# EAGLE board Mk4 Final a (EAGLE 9.0.1), part 1 of 3 (continued)
## Placement (x,y rotation side) (continued)
C90  0402/4u7/6V3/X5R  [C0402-SMALLER]  16.7,30.2 90 bottom
C91  0402/100n/10V/X5R  [C0402-SMALLER]  15.8,15 270 bottom
C92  0402/100n/10V/X5R  [C0402-SMALLER]  23.8,22.25 270 bottom
C93  0805/10u/10V/X5R  [C0805-N]  24.3,28.75 180 bottom
C94  0402/100n/10V/X5R  [C0402-SMALLER]  11.3,22.25 0 bottom
C95  0402/100n/10V/X5R  [C0402-SMALLER]  24.55,25.75 180 bottom
C96  0402/100n/10V/X5R  [C0402-SMALLER]  24.8,18.75 180 bottom
C97  0402/100n/10V/X5R  [C0402-SMALLER]  16.8,15 270 bottom
C98  0402/12p/50V/C0G  [C0402-SMALLER]  10.75,20.25 270 bottom
C99  0402/12p/50V/C0G  [C0402-SMALLER]  10.75,18.25 90 bottom
C100  0402/12p/50V/C0G  [C0402-SMALLER]  27.55,21.75 270 bottom
C101  0402/12p/50V/C0G  [C0402-SMALLER]  27.55,23.75 90 bottom
C102  0402/100n/10V/X5R  [C0402-SMALLER]  74.8,19.5 180 bottom
C103  0402/120p/50V/C0G  [C0402-SMALLER]  27.75,14.35 270 bottom
C104  0402/100n/10V/X5R  [C0402-SMALLER]  84.05,10 90 bottom
C105  0402/220n/6V3/X5R  [C0402-SMALLER]  23.75,60.4 180 bottom
C106  0402/220n/6V3/X5R  [C0402-SMALLER]  23.8,57.5 180 bottom
C107  0402/100n/10V/X5R  [C0402-SMALLER]  79.15,6.5 270 bottom
C108  0402/100n/10V/X5R  [C0402-SMALLER]  85.8,9.5 270 bottom
D1  MMSZ5231BT1G  [SOD123]  98.8,25.5 90 bottom
D2  LXES15AAA1-153  [R0402-SMALLER]  111.8,34.5 0 bottom
FID1  FIDUCIAL1X2.5-STOP  [FIDUCIAL-1X2.5-STOP]  95.1,11.1 270 top
FID2  FIDUCIAL1X2.5-STOP  [FIDUCIAL-1X2.5-STOP]  2.1,14.5 180 bottom
FID3  FIDUCIAL1X2.5-STOP  [FIDUCIAL-1X2.5-STOP]  82.9,67.9 180 top
FID4  FIDUCIAL1X2.5-STOP  [FIDUCIAL-1X2.5-STOP]  82.9,67.9 180 bottom
FID5  FIDUCIAL1X2.5-STOP  [FIDUCIAL-1X2.5-STOP]  2.1,14.5 180 top
FID6  FIDUCIAL1X2.5-STOP  [FIDUCIAL-1X2.5-STOP]  95.1,11.1 270 bottom
FL1  DEA202450BT-1294C1-H  [DEA202450BT]  10.8,25.75 270 bottom
IC1  MSP432E401  [QFP128-0.4]  59.8,53 0 bottom
IC2  AS4C4M16SA-7TCN  [TSOP54-400]  36.5,52.7 270 bottom
IC3  HDC2080DMBR  [SHT2X]  81.9,7 90 bottom
IC4  TCA9555RGER  [QFN-24]  78.05,26 270 bottom
IC5  SIM800C24 S2-10686-Z1L09  [SIM800C]  100.3,41 180 bottom
IC6  MX25R8035FM1IH1  [SO08-EIAJ]  72.5,43.15 270 bottom
IC7  TPD3E001DRL  [DRL-5]  76.05,73.5 90 bottom
IC8  BQ25601  [QFN-24]  41.05,24 270 bottom
IC9  TPS62822DLCR  [VSON-HR]  31.5,14.1 180 bottom
IC10  TPD3E001DRL  [DRL-5]  109.05,30.4 270 bottom
IC11  TLV9002IDGK  [VSSOP8]  80.8,54 180 bottom
IC12  SN74HC4066D  [SO14]  90.8,54.5 0 bottom
IC13  TPA2006D1  [VSON-8]  20.6,53.95 270 bottom
IC14  MX25R1635FM1IL0  [SO08-EIAJ]  13.55,40.25 90 bottom
IC15  CC3120R  [VQFN-64]  17.3,22.5 0 bottom
IC16  TMP102AIDRLR  [SOT563]  74.8,21 270 bottom
IC17  OPT3001DNPR  [USON-6]  83.1,10 180 top
IC18  DRV5055A1QDBZR  [SOT23-3]  88.05,9.25 180 bottom
J1  78723-1001  [MSIM-MOLEX-LWK]  117.3,22.25 180 bottom
J2  ER-CON50HT-1  [FH12-50S-0.5SH]  59.8,33.5 0 bottom
J3  2x5 1.27mm  [PINHEAD_2X05_127]  89.7,62.2 0 bottom
J4  GSM-COIL-ANT  [GSM-ANTENNA]  116.3,34.75 0 bottom
J5  S2B-PH-SM4-TB(LF)(SN)  [JST-2-SMD]  88.6,15.8 90 bottom
J7  SMA-142-0711-821/826  [J502-ND-142-0711-821/826-LWK1]  119.6,34.75 0 bottom
J8  H4P-SMD-2.0  [HW4-2.0-SWD-COMBINED]  39.55,74 172 bottom
J9  PJ-393-A  [PJ-393-A]  25.55,76.6 256 bottom
J10  H4P-SMD-2.0  [HW4-2.0-SWD-COMBINED]  14.55,67.75 160 bottom
J11  M02X2  [2X2]  100.3,9.65 315 bottom
JP1  1x5 1.27mm  [1X05-1.27MM]  11.82,14 0 bottom
JP2  1x03  [1X03_LOCK]  57.26,77.9 180 bottom
JP3  1x02 2MM  [1X02_2MM]  41.55,8.25 0 bottom
JP4  TC2030-MCP-NL  [TC2030-MCP-NL]  84.25,63.9 270 bottom
JP5  1x4 1.27mm  [1X04-1.27MM]  28.8,30.5 90 bottom
JP6  1x8  [1X08_LOCK]  2.05,26.75 90 bottom
JP7  1x14  [1X14_LOCK]  43.29,70.5 180 bottom
JP8  1x6  [1X06]  80.3,77 191 bottom
JP9  1x04_1.27MM  [1X04-1.27MM]  113.3,49.8 0 bottom
L1  SRN2512-2R2M  [1008]  36.05,19.75 270 bottom
L2  BLM18KG121TN1D  [WUERTH-0805]  66.3,72.75 0 bottom
L3  0402/0R/5%  [L0402]  112.3,37 270 bottom
L4  DFE201610E-R47M=P2  [0806]  35.3,15.15 90 bottom
L5  0402/0R/5%  [L0402]  110.55,66.5 110 bottom
L6  0402/0R/5%  [L0402]  3.8,23 0 bottom
L7  LQM2HPN2R2MG0L  [1008]  14.3,33.2 180 bottom
L8  LQM2HPN1R0MG0L  [1008]  17.3,33.5 270 bottom
L9  LQM2HPN2R2MG0L  [1008]  23.8,32 270 bottom
LAYERS1  LAYER_NUMBRS_4_SMALL  [LAYER_NUMBERS_4_SMALL]  57.3,23.5 0 top
LCD  ER-TFT024-3  [ER-TFT024-3]  59.8,33.5 0 top
LED1  WS2812B  [WS2812B]  52.3,76.5 180 top
LED2  WS2812B  [WS2812B]  67.3,76.5 180 top
LED3  0603 RED  [LED-0603-CORRECT]  61.07,74.5 90 top
LED4  0603 GREEN  [LED-0603-CORRECT]  58.53,74.5 90 top
LED5  LED 5MM  [LED5MM]  33.8,10 0 top
LED6  0603 RED  [LED-0603-CORRECT]  43.55,28.75 180 bottom
LOGO1  LOGO_SIM  [SIM_ICON]  98.8,20 0 bottom
LOGO2  LOGO_MICROPYTHON-6MM  [LOGO_MICROPYTHON_6MM]  78.55,45.7 0 bottom
LOGO3  LOGO_HCD-4MM  [LOGO_HDC_4MM]  76.2,57.4 0 bottom
LOGO4  LOGO_TI-BY-4MM  [LOGO_TI_BY_4MM]  82.3,62 0 bottom
LOGO5  EMFLOGO-2018-6MM  [EMFLOGO-2018-6MM]  22.3,42 90 bottom
LOGO6  LOGO-SEEEDSTUDIO-SILK  [LOGO_SILK]  49.8,76 0 bottom
PCB  TiLDA Mk4 PCB  [TILDA_MK4_OUTLINE_TALL_V1]  59.8,0 0 top
Q1  2N7002PW  [SC70-3-R]  90.3,29.5 90 bottom
Q2  2N7002PW  [SC70-3-R]  105.8,13.75 90 bottom
Q3  CSD25402Q3A  [Q3A]  39.55,15.75 0 bottom
Q8  CSD13202Q2  [Q2]  74.3,38.75 270 bottom
R1  0402/1K/5%  [R0402-SMALLER]  44.3,67.5 270 bottom
R2  0402/1K/5%  [R0402-SMALLER]  45.3,67.5 270 bottom
R3  0402/4K87/5%  [R0402-SMALLER]  50.05,57.25 0 bottom
R4  0402/10K/5%  [R0402-SMALLER]  58.3,65.25 180 bottom
R5  0402/1M/5%  [R0402-SMALLER]  50.55,59.75 90 bottom
R6  0402/2K/5%  [R0402-SMALLER]  63.55,62.95 90 bottom
R7  0402/1M/5%  [R0402-SMALLER]  77.55,78 270 bottom
R8  0402/100R/5%  [R0402-SMALLER]  78.05,74.5 180 bottom
R9  0402/10K/5%  [R0402-SMALLER]  67.3,44.25 270 bottom
R10  0402/10K/5%  [R0402-SMALLER]  77.8,41.75 90 bottom
R11  [0309/10]  23.3,12.25 180 top
R12  0402/2K/5%  [R0402-SMALLER]  61.07,74.5 270 bottom
R13  0402/10K/5%  [R0402-SMALLER]  37.55,15.25 90 bottom
R14  0402/2K/5%  [R0402-SMALLER]  58.53,74.5 270 bottom
R15  0402/10K/5%  [R0402-SMALLER]  45.55,23.25 0 bottom
R16  0402/10K/5%  [R0402-SMALLER]  45.55,22.25 180 bottom
R17  0402/2K/5%  [R0402-SMALLER]  45.55,24.25 180 bottom
R18  0402/10K/5%  [R0402-SMALLER]  41.05,30.5 180 bottom
R19  0402/10K/5%  [R0402-SMALLER]  41.05,29.5 180 bottom
R20  0402/10K/5%  [R0402-SMALLER]  41.55,28 90 bottom
R21  0402/4K7/5%  [R0402-SMALLER]  45.85,48.25 90 bottom
R22  0402/4K7/5%  [R0402-SMALLER]  46.85,48.25 90 bottom
R23  0402/4K7/5%  [R0402-SMALLER]  72.05,49 180 bottom
R24  0402/4K7/5%  [R0402-SMALLER]  72.05,47.75 180 bottom
R25  0402/100K/5%  [R0402-SMALLER]  24.8,16.75 180 bottom
R26  0402/51R/5%  [R0402-SMALLER]  97.3,52.5 90 bottom
R27  0402/51R/5%  [R0402-SMALLER]  99.3,52.5 90 bottom
R28  0402/51R/5%  [R0402-SMALLER]  100.3,52.5 90 bottom
R29  0402/4K7/5%  [R0402-SMALLER]  106.3,30.75 180 bottom
R30  0402/100K/5%  [R0402-SMALLER]  88.3,29.5 90 bottom
R31  0402/1K/5%  [R0402-SMALLER]  89.8,41.25 180 bottom
R32  0402/1K/5%  [R0402-SMALLER]  89.8,42.25 180 bottom
R33  0402/1K/5%  [R0402-SMALLER]  89.8,39.25 180 bottom
R34  0402/1K/5%  [R0402-SMALLER]  89.8,38.25 180 bottom
R35  0402/1K/5%  [R0402-SMALLER]  89.8,37.25 180 bottom
R36  0402/1K/5%  [R0402-SMALLER]  89.8,33.25 180 bottom
R37  0402/1K/5%  [R0402-SMALLER]  89.8,35.25 180 bottom
R38  0402/5K6/5%  [R0402-SMALLER]  89.8,34.25 0 bottom
R39  0402/5K6/5%  [R0402-SMALLER]  89.8,36.25 0 bottom
R40  0402/5K6/5%  [R0402-SMALLER]  89.8,40.25 0 bottom
R41  0402/1K/5%  [R0402-SMALLER]  89.8,32.25 180 bottom
R42  0402/1K/5%  [R0402-SMALLER]  89.8,31.25 180 bottom
R43  0402/10K/5%  [R0402-SMALLER]  80.55,47 90 bottom
R44  0402/12R/5%  [R0402-SMALLER]  69.3,39 270 bottom
R45  0402/10K/5%  [R0402-SMALLER]  81.55,47 90 bottom
R46  0402/10K/5%  [R0402-SMALLER]  82.05,49.5 180 bottom
R47  0402/12R/5%  [R0402-SMALLER]  72.3,39 270 bottom
R48  0402/12R/5%  [R0402-SMALLER]  71.3,39 270 bottom
R49  0402/12R/5%  [R0402-SMALLER]  70.3,39 270 bottom
R50  0402/22K/5%  [R0402-SMALLER]  80.05,49.5 0 bottom
R51  0402/22K/5%  [R0402-SMALLER]  80.05,48.5 0 bottom
R52  0402/15K/5%  [R0402-SMALLER]  80.3,58.75 180 bottom
R53  0402/8K2/5%  [R0402-SMALLER]  78.3,58.75 0 bottom
R54  0402/10K/5%  [R0402-SMALLER]  85.3,54.5 270 bottom
R55  0402/10K/5%  [R0402-SMALLER]  87.55,49.75 180 bottom
R56  0402/10K/5%  [R0402-SMALLER]  94.05,59.5 180 bottom
R57  0402/150K/1%  [R0402-SMALLER]  21.75,59.45 0 bottom
R58  0402/150K/1%  [R0402-SMALLER]  21.75,58.45 0 bottom
R59  0402/10K/5%  [R0402-SMALLER]  103.8,13.75 90 bottom
R60  0402/732K/5%  [R0402-SMALLER]  28.75,14.35 270 bottom
R61  0402/162K/5%  [R0402-SMALLER]  29.75,14.35 90 bottom
R62  0402/10K/5%  [R0402-SMALLER]  11.8,16.75 270 bottom
R63  0402/100K/5%  [R0402-SMALLER]  9.05,35.2 90 bottom
R64  0402/100K/5%  [R0402-SMALLER]  10.05,35.2 90 bottom
R65  0402/100K/5%  [R0402-SMALLER]  12.8,16.75 270 bottom
R66  0402/10K/5%  [R0402-SMALLER]  8.3,40.25 90 bottom
R67  0402/100K/5%  [R0402-SMALLER]  10.8,37.25 180 bottom
R68  0402/100K/5%  [R0402-SMALLER]  24.8,19.75 180 bottom
R69  0402/100K/5%  [R0402-SMALLER]  24.8,17.75 180 bottom
R70  0402/100K/5%  [R0402-SMALLER]  26.55,26.5 90 bottom
R71  0402/100K/5%  [R0402-SMALLER]  18.3,16.25 270 bottom
R72  0402/100K/5%  [R0402-SMALLER]  13.8,15 270 bottom
R73  0402/100K/5%  [R0402-SMALLER]  9.05,29 90 bottom
R74  0402/10K/5%  [R0402-SMALLER]  18.55,56.5 0 bottom
R75  0402/0R/5%  [R0402-SMALLER]  20.8,61.5 180 bottom
R76  0402/10K/5%  [R0402-SMALLER]  73.8,27.75 90 bottom
R77  0402/150K/1%  [R0402-SMALLER]  21.75,60.4 0 bottom
R78  0402/150K/1%  [R0402-SMALLER]  21.8,57.5 0 bottom
S1  SKPMAPE010  [SKPMAPE010-COMBINED]  87.8,53.5 0 top
S2  SKPMAPE010  [SKPMAPE010-COMBINED]  100.3,53.5 0 top
S3  SKPMAPE010  [SKPMAPE010-COMBINED]  112.8,53.5 0 top
S4  SKPMAPE010  [SKPMAPE010-COMBINED]  87.8,41 0 top
S5  SKPMAPE010  [SKPMAPE010-COMBINED]  100.3,41 0 top
S6  SKPMAPE010  [SKPMAPE010-COMBINED]  112.8,41 0 top
S7  SKPMAPE010  [SKPMAPE010-COMBINED]  87.8,28.5 0 top
S8  SKPMAPE010  [SKPMAPE010-COMBINED]  100.3,28.5 0 top
S9  SKPMAPE010  [SKPMAPE010-COMBINED]  112.8,28.5 180 top
S10  SKPMAPE010  [SKPMAPE010-COMBINED]  87.8,16 0 top
S11  SKPMAPE010  [SKPMAPE010-COMBINED]  100.3,16 0 top
S12  SKPMAPE010  [SKPMAPE010-COMBINED]  112.8,16 0 top
S13  SKPMAPE010  [SKPMAPE010-COMBINED]  10.6,48 135 top
S14  SKPMAPE010  [SKPMAPE010-COMBINED]  20.6,53 180 top
S15  SKPMAPE010  [SKPMAPE010-COMBINED]  30.6,48 45 top
S16  3X6X2.5  [TACTILE_SWITCH_SMD_3X6X2.5H]  29.8,68 15 top
S17  3X6X2.5  [TACTILE_SWITCH_SMD_3X6X2.5H]  89.8,68 345 top
S18  CUS-12TB  [SWITCH-SPST-SMD-A]  59.8,7.1 180 bottom
S19  3X6X2.5  [TACTILE_SWITCH_SMD_3X6X2.5H]  71.8,8.25 180 bottom
S20  3X6X2.5  [TACTILE_SWITCH_SMD_3X6X2.5H]  47.8,8.25 180 bottom
S22  AYZ0202AGRLC  [AYZ-JS-COMBINED]  100.3,59.5 90 bottom
SW1  JOYSTICK  [JOYSTICK_MULTICOMP_NOSILK]  20.6,39 315 top
TP1  TP  [B1,27]  52.2,60.7 0 bottom
TP2  TP  [B1,27]  87.8,41.5 0 bottom
TP3  TP  [B1,27]  87.3,39.75 0 bottom
TP4  TP  [B1,27]  86.05,38.5 0 bottom
TP5  TP  [B1,27]  87.55,37.25 0 bottom
TP6  TP  [B1,27]  77.8,76 270 bottom
TP7  TP  [B1,27]  63.55,74 0 bottom
TP8  TP  [B1,27]  87.55,35.25 0 bottom
TP9  TP  [B1,27]  87.55,33.25 0 bottom
TP10  TP  [B1,27]  87.8,43.25 0 bottom
TP11  TP  [B1,27]  85.8,32.5 0 bottom
TP12  TP  [B1,27]  86.3,30.75 0 bottom
TP13  TP  [B1,27]  86.3,29 0 bottom
TP14  TP  [B1,27]  43.8,17 0 bottom
TP15  TP  [B1,27]  41.8,13.5 0 bottom
TP16  TP  [B1,27]  33.3,22 0 bottom
TP17  TP  [B1,27]  31.55,22 0 bottom
TP18  TP  [B1,27]  45.8,15.5 0 bottom
TP19  TP  [P1-06-OCT-CAN]  22.4,17.2 0 bottom
U1  ZX62-B-5PA(33)  [USB-AB-MICRO-SMD_LWK]  70.2,78 274 bottom
U4  MIC-6MM  [MIC-SMD-6MM]  95.3,70 270 bottom
U5  LDMS1540S-01-R8-0.8-R  [SPEAKER-15MM-SMD]  8.05,54.5 270 bottom
X1  ABS07-32.768KHZ-T  [RESONATOR_EPSON_FC_145]  54.2,64.75 180 bottom
X2  ABM8G-25.000MHZ-B4Y-T  [CRYSTAL-3.2-2.5]  62.55,66.55 180 bottom
X3  ABS07-32.768KHZ-T  [RESONATOR_EPSON_FC_145]  25.8,22.75 90 bottom
X4  ABM8-40.000MHZ-10-1-U-T  [CRYSTAL-3.2-2.5]  8.6,19.25 270 bottom

## Tracks (layer width: path | path; a pad name or v marks a point on that pad's centre or on a via)
3V3  (via drill 0.3)  (5 unrouted)
  Top 0.2: IC17.1 84.49,9.35 arc45 v84.85,9.5
  Top 0.3: SW1.COM 23.38,36.17 v22.3,37.25
  Bottom 0.15: v74.3,18.75 C102.1 73.8,19.5 arc-90 73.3,20 73.3,20.16 arc-90 IC16.5
  Bottom 0.2: IC1.9 62.8,43.75 C13.2 | IC1.8 63.2,46.19 arc-45 63.35,46.55 v63.55,46.75 63.6,46.7 IC1.7 | IC1.16 60,44.01 arc45 60.15,43.65 C12.2 v60.3,42.75 | IC1.47 51.26,52.4 arc45 C10.2 | IC1.113 67.94,52.8 arc45 68.64,53.09 C9.2 | IC1.79 59.2,61.44 arc45 58.91,62.14 C11.2 | IC1.69 55.2,59.86 arc-45 v55.05,59.5 54.95,59.6 arc-45 54.8,59.96 IC1.68 | 20.55,27.28 IC15.47 | IC1.90 63.6,59.55 v63.55,59.5 | IC1.51 v50.8,54 50.91,54.11 arc-45 51.61,54.4 IC1.52 | IC1.39 v53.3,49.2 | IC1.28 55.2,44.35 arc90 v55.55,44 arc90 56,44.45 IC1.26 | R9.1 v67.3,45.5 | IC1.122 66.42,49.2 arc-45 v66.3,49.25 | v84.85,9.5 C104.1 | IC1.101 68.75,57.6 v68.9,57.45 | R24.2 v72.55,47 | R23.2 72.87,49.32 arc-45 v73.3,49.5 | R66.1 8.3,39.5 arc-45 v8.05,38.9
  Bottom 0.25: J2.41 52.05,38 | J2.40 52.55,37.29 arc45 52.4,37.65 52.05,38 | J2.42 51.55,37.29 arc-45 51.7,37.65 52.05,38 | J2.35 v55.05,35.5 | J2.1 v72.05,35.5 | J2.8 v68.55,38 | J2.7 69.05,37.5 v68.55,38 | J2.9 68.05,37.5 v68.55,38 | C13.2 63.05,42.12 C14.2 63.3,41.62 v63.3,40.75 | v49.8,52.1 C10.2 | v70.05,53.75 C9.2 | v58.8,63 C11.2 | R4.2 v58.8,66 | R5.2 v49.8,60.25 | C89.1 19.96,28.5 arc45 19.26,28.21 arc45 19.05,27.71 IC15.44 | IC15.39 16.55,29.55 C90.1 | IC15.37 15.55,29.35 C88.1 | C91.1 v15.8,16.25 16.26,16.71 arc45 16.55,17.41 IC15.10 | C92.1 v23.8,23.5 23.7,23.6 arc45 23.34,23.75 IC15.54 | IC4.21 C21.2 | v73.8,30.3 R76.2 | JP7.8 62.15,71.71 arc45 62.3,72.06 C3.2 | IC13.6 20.92,51.02 v20.85,50.95 C58.1
  Bottom 0.3: 21.02,27.75 20.55,27.28 | R73.2 v9.05,30.25 | JP4.1 85.43,62.63 v85.8,63 | IC12.14 94.61,59.44 R56.2 C71.2 v93.55,60.5 | IC6.8 69.15,46.15 C2.2 v69.05,47 | R10.1 v77.8,40.5 | C28.2 42.23,42.25 IC2.27 42.13,42.25 v41.05,42.25 | v32.05,54.5 arc-45 31.57,54.3 IC2.43 29.6,54.3 C24.2 | v32.05,59 31.95,59.1 IC2.49 29.65,59.1 C27.2 | v41.05,61.5 IC2.3 C22.2 | v41.05,63.25 41.2,63.1 IC2.1 43.45,63.1 C26.2 | v41.05,56.75 41.1,56.7 IC2.9 43.5,56.7 C23.2 | v41.05,52.75 41.1,52.7 IC2.14 43.5,52.7 C25.2 | C42.2 v25.8,34.5 | C42.2 26.55,35 v26.55,34.5 | C42.2 25.05,35 v25.05,34.5 | v78.8,49.5 R50.2 | C103.1 R60.1 | R22.2 R21.2 v45.1,48.75 | C88.1 v14.65,29.5 | C4.2 68.69,68.61 JP7.11 | v80.4,50.45 C70.2 79.83,50.73 IC11.8 | J10.7 J10.3 | J8.7 J8.3 | IC3.5 C107.1 v78.4,7
  Bottom 0.4: 21.02,27.75 21.99,27.75 arc45 22.69,28.04 C93.1 23.4,29.39 arc-45 23.55,29.75 v23.8,30 | v21.05,29.75 21.05,29.66 arc-45 20.76,28.96 20.5,28.7 C89.1 20.3,28.7 v20.3,29.75 | C90.1 16.9,29.7 v17.45,30.25 | v26.05,19.75 R68.2 | v26.05,17.75 R69.2 | v15.8,36.15 16.3,36.15 arc90 17.3,37.15 C59.2 17.3,37.53 arc45 17.01,38.24 IC14.8 | R67.2 v12.05,37.25 | v74.3,26.5 C21.2 | v28.75,15.6 R60.1 | C43.2 v20.3,13 | C43.2 20.8,13.75 v20.3,13.75 | C43.2 20.8,12.25 v20.3,12.25 | IC18.1 86.85,10 C108.1 85.76,10 arc45 85.06,9.71 v84.85,9.5 | TP16.TP 33.35,21.95 v33.35,20.65
  Bottom 0.5: C5.2 76.94,70 JP7.14
  other vias: 52.3,41.25 32.95,20.15 33.75,20.15 34.1,24.35 33.8,23.35 33.5,23.95
  pour 3V3@2 (isolate 0.254, rank 6): 0,62.5 0,9 arc31 31.8,0 34.5,0 arc90 37.3,2.8 arc-90 39.3,4.8 80.3,4.8 arc-90 82.3,2.8 arc90 85.1,0 87.8,0 arc31 119.6,9 119.6,32.5 113.3,32.5 113.3,62.5 119.6,62.5 arc64 113.05,70.25 arc24 59.8,80.5 arc24 6.55,70.25 arc55
  pour Bottom (no thermals): 52.05,40 52.05,41.3 52.25,41.5 52.6,41.5 52.8,41.3 52.8,39.75 52.3,39.25 52.3,37.75 51.8,37.75 51.8,39.75
  pour Bottom (no thermals): 36.1,15.65 34.55,15.65 34.15,16.05 arc45 33.79,16.2 32.65,16.2 32.65,23.39 arc-45 32.8,23.75 33.65,24.6 arc-45 34.01,24.75 34.05,24.75 arc-90 34.55,24.25 34.55,24.11 arc-45 34.4,23.75 34.25,23.6 arc45 34.1,23.24 34.1,17.4 arc90 34.6,16.9 35.6,16.9 arc-90 36.1,16.4
  pour Top: 24.15,34.85 22.45,33.15 arc-45 22.09,33 16.21,33 arc45 15.51,32.71 14.59,31.79 arc45 14.3,31.09 14.3,28 arc90 15.3,27 20.89,27 arc45 21.59,27.29 25.51,31.21 arc45 25.8,31.91 25.8,32.29 arc-45 25.95,32.65 27.15,33.85 arc45 27.3,34.21 27.3,34.5 arc90 26.8,35 24.51,35 arc45
!HIB
  Bottom 0.2: IC1.65 53.6,61.24 arc45 53.45,61.6 53.4,61.65 arc90 52.7,61.65 52.2,61.15 TP1.TP
!RESET  (via drill 0.3)
  Top 0.15: v77.5,44.2 77.5,43.81 arc-45 77.21,43.11 76.62,42.52 arc45 76.33,41.81 76.33,35.15 arc-45 76.3,35.08 76.23,35.01 arc45 76.2,34.94 76.2,31.76 arc-45 75.91,31.06 74.04,29.19 arc-45 73.34,28.9 72.11,28.9 arc45 71.41,28.61 v68.3,25.5
  Top 0.2: J3.10 86.63,62.84 arc45 86.4,62.27 86.4,58.05 arc-90 85.4,57.05 v78,57.05 76.99,58.06 arc45 76.29,58.35 68.26,58.35 arc-45 67.55,58.64 65.94,60.25 arc45 65.59,60.4 65.47,60.4 arc-45 64.76,60.69 61.82,63.63 arc-45 61.53,64.34 arc45 61.4,64.65 59.63,66.42 arc90 58.22,66.42 v58.05,66.25
  3V3@2 0.15: v78,57.05 78,54.8 76.42,53.23 76.42,52.38 76.3,52.26 76.3,46.65 77.5,45.45 v77.5,44.2
  Bottom 0.15: IC1.70 55.6,61.59 arc-45 55.75,61.95 56.05,62.25 arc-45 56.41,62.4 56.59,62.4 arc45 56.95,62.55 57.65,63.25 arc45 57.8,63.61 C15.2 | R4.1 57.8,65.79 arc-45 57.95,66.15 v58.05,66.25 | v68.3,25.5 68.3,19.82 arc45 68.81,18.59 73.89,13.51 arc45 75.12,13 78.25,13 arc-90 79.5,11.75 79.5,10.16 arc-45 79.21,9.46 78.21,8.46 arc-45 78.07,8.4 77.36,8.4 arc45 77.22,8.34 77.18,8.31 arc-45 77.04,8.25 S19.2
  Bottom 0.2: C15.2 R4.1
!WAKE  (via drill 0.3)
  Top 0.15: v54.3,59.2 55.91,57.59 arc45 56.61,57.3 59.67,57.3 arc45 60.02,57.45 60.61,58.03 arc-45 61.31,58.33 65.03,58.33 arc-45 65.56,58.1 68.2,55.47 arc45 68.91,55.17 70.04,55.17 70.07,55.2 74.34,55.2 arc45 75.05,55.49 75.32,55.77 arc-45 75.47,55.83 75.73,55.83 arc-45 75.88,55.77 75.98,55.66 arc45 76.12,55.6 76.29,55.6 arc-45 76.99,55.31 v78.3,54 | v69.3,25.5 69.32,25.52 arc-45 69.55,26.07 71.78,28.31 arc-45 72.49,28.6 73.46,28.6 arc45 74.17,28.89 76.21,30.93 arc45 76.5,31.64 76.5,34.82 arc-45 76.53,34.89 76.6,34.96 arc45 76.62,35.03 76.62,41.66 arc-45 76.92,42.37 v78.02,43.48
  3V3@2 0.15: v78.02,43.48 78.02,44.58 77.9,44.7 77.9,45.48 76.6,46.78 76.6,52.13 76.72,52.26 76.72,52.42 v78.3,54
  Bottom 0.15: S20.2 52.05,8.25 53.01,7.29 arc45 53.71,7 56.68,7 arc-45 57.38,6.71 57.77,6.32 arc45 58.12,6.17 61.48,6.17 arc45 61.83,6.32 62.21,6.71 arc-45 62.92,7 75.89,7 arc45 76.59,7.29 77.34,8.04 arc-45 77.48,8.1 78.19,8.1 arc45 78.33,8.16 79.43,9.26 arc45 79.8,10.14 79.8,11.8 arc90 78.3,13.3 75.2,13.3 arc-45 74.14,13.74 69.14,18.74 arc-45 68.7,19.8 68.7,24.49 arc-45 68.99,25.19 v69.3,25.5 | IC1.64 v54.3,59.2
  Bottom 0.2: IC1.64 50.5,59.2 R5.1
ADC1_HALL  (via drill 0.3)
  Top 0.15: v70.8,41 v72.05,41
  Bottom 0.15: IC1.13 61.2,43.06 arc-45 60.91,42.36 60.84,42.29 arc45 60.55,41.59 60.55,40.5 arc90 61.55,39.5 66.14,39.5 arc45 66.84,39.79 67.47,40.42 arc-45 68.18,40.72 70.34,40.72 70.63,41 v70.8,41 | v72.05,41 72.76,40.29 arc45 73.46,40 75.39,40 arc-45 76.09,39.71 81.91,33.89 arc-45 82.2,33.19 82.2,27.32 arc45 82.71,26.09 87.59,21.21 arc45 88.83,20.7 92.3,20.7 arc-90 93.3,19.7 93.3,11.91 arc-45 93.01,11.21 92.34,10.54 arc-45 91.64,10.25 IC18.2
AIN6_SPK_ADC  (via drill 0.3)
  Top 0.15: v75.5,53.4 75.6,53.4 arc-90 76.6,52.4 76.6,52.01 arc-45 76.31,51.31 74.27,49.27 arc-45 73.56,48.98 70.62,48.98 70.55,49.05 arc45 70.19,49.2 69.9,49.2 arc90 69.4,48.7 69.4,48.5 arc90 69.9,48 v70.6,48
  Bottom 0.15: R46.2 82.55,52.4 arc90 81.55,53.4 80.4,53.4 | v75.5,53.4 80.4,53.4 | v70.6,48 69.51,48 arc45 69.15,47.85 69.05,47.75 arc-45 68.69,47.6 IC1.126 | IC11.7 80.47,53.33 80.4,53.4
AMP_!SHUTDOWN  (via drill 0.3)
  Top 0.15: v23.8,56.5 v19.85,56.5
  3V3@2 0.15: v48.55,52.5 48.55,52.05 48.35,51.85 48.35,43.55 v45.3,40.5
  Bottom 0.15: IC1.46 51.57,52 arc45 51.22,51.85 51.09,51.72 arc-45 50.74,51.58 49.68,51.58 arc-45 49.33,51.72 v48.55,52.5 | v45.3,40.5 44.89,40.91 arc45 44.19,41.2 31.58,41.2 arc-45 31.44,41.26 31.36,41.34 arc45 31.22,41.4 30.56,41.4 arc-45 29.86,41.69 29.34,42.21 arc-45 29.05,42.91 29.05,44.34 arc45 28.76,45.04 27.27,46.53 arc45 26.92,46.67 26.71,46.67 arc-90 25.97,47.41 arc45 25.68,48.12 25.59,48.21 arc-45 25.3,48.91 25.3,53.59 arc45 25.01,54.29 24.09,55.21 arc-45 23.8,55.91 v23.8,56.5
  Bottom 0.2: IC13.1 19.62,55.86 arc-45 19.85,56.4 v19.85,56.5 R74.1
AMP_IN_N
  Bottom 0.2: 21.22,58.48 R58.2 21.25,57.55 R78.2 21.57,57.23 IC13.4
AMP_IN_P  (2 unrouted)
  Bottom 0.2: R57.2 R77.2 21.25,61.5 | J9.3 26.56,69.04 arc45 25.85,68.75 J9.2 23.9,66.8 23.6,66.8 21.54,64.74 arc45 21.25,64.04 21.25,61.5 | R75.2 21.25,61.5
AMP_IN_R1_N
  Bottom 0.15: C106.1 R78.1
AMP_IN_R1_P
  Bottom 0.15: C105.1 R77.1
AMP_IN_R_N
  Bottom 0.2: R58.1 C82.1
AMP_IN_R_P
  Bottom 0.2: R57.1 C83.1
AMP_IN_TRS_P  (2 unrouted)
  Bottom 0.2: J9.5 32.51,67.83 arc45 32.8,68.54 32.8,69.35 arc90 31.8,70.35 30.31,70.35 arc45 29.61,70.06 29.34,69.79 arc-45 28.64,69.5 23.88,69.5 J9.6 23.12,69.41 arc45 22.42,69.12 22.09,68.79 arc45 21.8,68.09 21.8,66.01 arc-45 21.51,65.31 20.59,64.39 arc45 20.3,63.69 R75.1 20.3,57.66 arc45 20.59,56.96 20.63,56.92 arc-45 20.92,56.21 IC13.3
BQ_!CE
  Bottom 0.15: R17.1 IC8.9
BQ_!INT  (via drill 0.3)
  Top 0.15: v60.8,47.2 60.8,46.66 arc-45 60.65,46.31 58.38,44.04 arc90 58.38,41.92 59.88,40.42 arc-45 60.1,39.89 60.1,39.53 arc-45 59.95,39.18 59.75,38.97 arc45 59.6,38.62 59.6,38.33 arc-45 59.09,37.09 58.61,36.61 arc-45 57.38,36.1 55.21,36.1 arc45 54.51,35.81 53.85,35.15 arc-90 53.15,35.15 v52.7,35.6
  Bottom 0.15: v60.8,47.2 IC1.14 | IC8.7 51.7,25.25 arc90 52.7,26.25 v52.7,35.6
BQ_!QON  (via drill 0.3)
  Top 0.15: v44.05,22.7 46.21,24.86 arc-45 46.55,25 arc-90 47.55,24 47.55,17.41 arc-45 47.26,16.71 46.09,15.54 arc45 45.8,14.84 45.8,13.65 arc-90 44.8,12.65 39.96,12.65 arc45 39.26,12.36 v38.05,11.15
  Bottom 0.15: IC8.12 44,22.75 v44.05,22.7 | JP3.2 38.34,9.46 arc-45 38.05,10.16 v38.05,11.15
BQ_PMID
  Bottom 0.3: IC8.23 38.22,24.75
  Bottom 0.4: C36.1 37.11,25.04 37.72,25.04 arc-45 38.07,24.9 38.22,24.75
BQ_PSEL
  Bottom 0.15: IC8.2 40.3,29.25 R19.1 R18.1
BQ_REGN  (via drill 0.3)
  Top 0.2: v37.8,24.25 37.8,22.75 arc90 38.8,21.75 45.89,21.75 arc45 46.59,22.04 v46.8,22.25
  Bottom 0.25: IC8.22 v37.8,24.25
  Bottom 0.3: R16.2 v46.8,22.25
  Bottom 0.4: C39.2 v37.8,24.25
BQ_STAT
  Bottom 0.15: IC8.4 41.3,27.25 R20.1
BQ_STAT_R
  Bottom 0.15: LED6.C 41.8,28.75 R20.2
BQ_SW
  pour Bottom (no thermals): 39.3,23.3 38.1,23.3 37.65,22.85 arc-45 37.29,22.7 36.81,22.7 arc-45 36.45,22.85 36.3,23 36.3,23.45 35.85,23.45 35.1,22.7 arc45 34.95,22.34 34.95,20.5 37.3,20.5 arc90 37.8,21 37.8,21.79 arc-45 37.95,22.15 38.5,22.7 39.3,22.7
BQ_TS
  Bottom 0.15: R16.1 R15.2 IC8.11
BT_ANT
  Bottom 0.4: IC5.20 103.6,51 arc-90 106.6,54 107.05,54 arc90 109.05,56 109.05,63.5 arc-21 109.8,64.5 arc-6 C74.2 arc-6 L5.1
BT_ANT_L
  Bottom 0.4: L5.2 arc-10 C75.2 111.08,68.22 arc85 110.8,68.75 arc15 ANT2.1
BTN_1  (via drill 0.3)
  Top 0.2: S1.B2 93.41,54.69 arc-45 93.7,53.99 93.7,47.25 arc-90 92.7,46.25 83.11,46.25 83.03,46.17 81.6,46.17 arc90 79.35,43.92 79.35,37.09 arc-45 79.06,36.38 77.42,34.74 arc45 77.12,34.04 77.12,31.31 arc-45 76.83,30.61 76.74,30.52 arc45 76.45,29.81 v76.45,28.85
  Top 0.3: S1.2 92.35,55.05 S1.B2 S1.B1
  Bottom 0.15: IC4.1 76.8,28.42 arc45 76.74,28.56 v76.45,28.85
BTN_2  (via drill 0.3)
  Top 0.2: S2.2 103.3,46.5 arc-90 102.3,45.5 95.28,45.5 95.23,45.55 83.4,45.55 83.33,45.48 81.8,45.48 arc90 80.05,43.73 80.05,37.01 arc-45 79.61,35.95 78.19,34.53 arc45 77.9,33.82 77.9,30.81 arc-45 77.61,30.11 v77.5,30
  Top 0.3: S2.2 104.85,55.05 S2.B2 S2.B1
  Bottom 0.15: IC4.3 77.8,29.29 arc45 v77.51,29.99 v77.5,30
BTN_3  (via drill 0.3)
  Top 0.2: S3.B1 107.09,54.59 arc45 106.8,53.89 106.8,46 arc-90 105.8,45 95.37,45 arc-45 95.23,45.06 95.15,45.14 arc45 95.01,45.2 83.55,45.2 83.47,45.12 81.9,45.12 arc90 80.4,43.62 80.4,36.97 arc-45 79.89,35.73 78.59,34.43 arc45 78.3,33.73 78.3,30.71 arc45 v78.59,30.01 v78.6,30
  Top 0.3: S3.2 117.35,55.05 S3.B2 S3.B1
  Bottom 0.15: IC4.4 78.3,29.29 arc-45 v78.59,29.99 v78.6,30
BTN_4  (via drill 0.3)
  Top 0.2: S4.B1 82.5,43.25 arc90 81.5,42.25 81.5,28.71 arc-45 81.21,28.01 v81.1,27.9
  Top 0.3: S4.2 92.35,42.55 S4.B2 91.56,43.25 arc45 90.86,42.96 90.69,42.8 arc-45 90.34,42.65 89.26,42.65 arc-45 88.91,42.8 88.74,42.96 arc45 88.04,43.25 S4.B1
  Bottom 0.15: IC4.7 80.45,27.25 v81.1,27.9
BTN_5  (via drill 0.3)
  Top 0.2: S5.B1 95.75,43.55 95.09,44.21 arc45 94.39,44.5 83.83,44.5 83.76,44.42 82.15,44.42 arc90 81.15,43.42 81.15,36.93 arc-45 80.49,35.34 79.39,34.24 arc45 79.1,33.54 79.1,31.19 arc45 79.39,30.48 arc-45 79.65,29.86 v79.65,28.85
  Top 0.3: S5.2 104.85,42.55 S5.B2 S5.B1
  Bottom 0.15: IC4.6 79.3,28.29 arc-45 79.45,28.65 v79.65,28.85
BTN_6  (via drill 0.3)
  Top 0.2: S6.B1 107.29,44.21 arc45 106.59,44.5 95.38,44.5 arc-45 95.24,44.56 arc45 94.53,44.85 83.69,44.85 83.61,44.77 82.05,44.77 arc90 80.8,43.52 80.8,36.97 arc-45 80.21,35.56 78.99,34.34 arc45 78.7,33.63 78.7,31.09 arc45 78.99,30.39 arc-45 79.15,30.01 79.15,29.77 79.1,29.72 v79.1,29.4
  Top 0.3: S6.2 117.35,42.55 S6.B2 S6.B1
  Bottom 0.15: IC4.5 78.8,28.69 arc-45 v79.09,29.39 v79.1,29.4
BTN_7  (via drill 0.3)
  Top 0.2: v81.43,27.17 82.96,28.7 arc45 83.25,29.4 S7.B1
  Top 0.3: S7.2 92.35,30.05 S7.B2 S7.B1
  Bottom 0.15: IC4.8 80.77,26.75 80.82,26.8 arc45 81.23,26.97 v81.43,27.17
BTN_8  (via drill 0.3)
  Top 0.2: S8.2 103.3,23.7 arc-90 102.3,22.7 94.51,22.7 arc45 93.81,22.41 93.59,22.19 arc-45 92.89,21.9 85.61,21.9 arc-45 84.91,22.19 v81.7,25.4
  Top 0.3: S8.2 104.85,30.05 S8.B2 S8.B1
  Bottom 0.15: IC4.10 80.81,25.75 80.83,25.73 80.96,25.73 arc-45 81.67,25.43 v81.7,25.4
BTN_9  (via drill 0.3)
  Top 0.2: v81.6,24.5 84.26,21.84 arc45 84.96,21.55 93.03,21.55 arc45 93.74,21.84 93.9,22.01 arc-45 94.61,22.3 104.19,22.3 arc45 104.89,22.59 108.25,25.95 S9.B2
  Top 0.3: S9.2 108.25,26.95 S9.B2 112.7,26.25 113.05,26.6 113.55,26.6 113.9,26.25 S9.B1
  Bottom 0.15: IC4.11 80.44,25.25 arc-45 81.14,24.96 v81.6,24.5
BTN_10  (via drill 0.3)
  Top 0.2: S10.B2 92.35,19.4 arc90 91.35,20.4 81.71,20.4 arc-45 81.01,20.69 v79.2,22.5
  Top 0.3: S10.2 92.35,17.55 S10.B2 S10.B1
  Bottom 0.15: IC4.14 78.8,23.31 arc45 78.95,22.95 79.06,22.84 arc-45 v79.2,22.5
BTN_11  (via drill 0.3)
  Top 0.2: S11.B2 104.85,20.6 arc90 103.85,21.6 94.91,21.6 arc45 94.21,21.31 93.99,21.09 arc-45 93.29,20.8 82.41,20.8 arc-45 81.71,21.09 v79.65,23.15
  Top 0.3: S11.2 104.85,17.55 S11.B2 S11.B1 | S11.B1 95.55,18.25 95.3,18 95.5,18 S11.B1
  Bottom 0.15: IC4.13 79.3,23.5 v79.65,23.15
BTN_12  (via drill 0.3)
  Top 0.2: S12.B1 104.84,21.66 arc45 104.14,21.95 94.75,21.95 arc45 94.05,21.66 93.88,21.49 arc-45 93.18,21.2 84.41,21.2 arc-45 83.71,21.49 v80.85,24.35
  Top 0.3: S12.2 117.06,17.26 arc45 117.35,17.96 S12.B2 S12.B1
  Bottom 0.15: IC4.12 80.45,24.75 v80.85,24.35
BTN_A  (via drill 0.3)  (3 unrouted)
  Top 0.15: v48.8,27.4 49.61,28.21 arc-45 50.31,28.5 62.78,28.5 arc-45 63.67,28.13 70.23,21.57 arc45 71.12,21.2 76.49,21.2 arc45 77.19,21.49 v77.8,22.1 | S13.B1 13.14,44.11 arc-45 13.85,44.4 17.99,44.4 arc-45 18.69,44.11 20.71,42.09 arc-45 21,41.39 v21,41
  Top 0.3: S13.2 7.98,49.63 S13.B2 S13.B1
  Bottom 0.15: IC4.16 v77.8,22.1 | v48.8,27.4 48.61,27.4 arc-45 47.91,27.69 45.79,29.81 arc45 44.91,30.18 43.99,30.18 arc-45 43.11,30.54 39.52,34.13 arc45 38.63,34.5 31.55,34.5 arc-45 31.41,34.56 31.2,34.77 arc45 31.06,34.83 30.52,34.83 arc-45 29.63,35.19 27.89,36.93 arc45 27.01,37.3 24.74,37.3 arc-45 24.03,37.59 23.09,38.53 arc45 22.21,38.9 22,38.9 arc-90 21,39.9 v21,41
BTN_B  (via drill 0.3)  (3 unrouted)
  Top 0.15: v77.2,22.6 76.39,21.79 arc-45 75.69,21.5 71.21,21.5 arc-45 70.51,21.79 63.89,28.41 arc45 62.83,28.85 49.86,28.85 arc45 49.16,28.56 v48.8,28.2 | S15.B2 31.32,51.9 v29.8,51.9 | v26.8,47.5 arc-45 26.72,47.3 S15.B1 25.6,46.18 25.6,41.82 arc-45 25.23,40.93 24.66,40.36 arc90 24.66,39.65 25.21,39.1 arc45 25.56,38.95 25.94,38.95 arc-45 26.3,38.8 27.01,38.09 arc45 27.71,37.8 v27.8,37.8
  Top 0.3: S15.2 32.72,52.31 S15.B2
  Bottom 0.15: IC4.17 77.3,22.7 v77.2,22.6 | v48.8,28.2 48.24,28.2 arc-45 47.53,28.49 45.99,30.04 arc45 44.93,30.48 44.02,30.48 arc-45 43.31,30.77 39.71,34.36 arc45 38.65,34.8 31.67,34.8 arc-45 31.53,34.86 31.32,35.07 arc45 31.18,35.12 30.59,35.12 arc-45 29.88,35.42 27.95,37.35 arc-45 27.8,37.71 v27.8,37.8 | v29.8,51.9 27.09,49.19 arc45 26.8,48.49 v26.8,47.5
BTN_CALL  (via drill 0.3)  (1 unrouted)
  Top 0.15: v78.45,22.6 78.45,22.26 arc-45 78.16,21.56 77.79,21.19 arc-45 77.09,20.9 71.02,20.9 arc-45 69.96,21.34 63.39,27.91 arc45 62.69,28.2 50.81,28.2 arc45 50.11,27.91 v49.6,27.4 | S16.2 27.66,63.1 arc45 27.07,61.69 27.07,50.19 arc-45 26.78,49.48 24.26,46.96 arc90 24.26,45.54 25.01,44.79 arc-45 25.3,44.09 25.3,41.91 arc-45 25.01,41.21 23.59,39.79 arc-45 22.88,39.49 21.82,39.49 arc-45 21.11,39.79 v20.4,40.5
  Bottom 0.15: IC4.15 78.3,22.75 v78.45,22.6 | v49.6,27.4 49.18,26.98 arc-90 48.12,26.98 45.52,29.58 arc45 44.81,29.88 43.97,29.88 arc-45 42.91,30.31 39.32,33.91 arc45 38.61,34.2 31.42,34.2 arc-45 31.28,34.26 31.08,34.47 arc45 30.93,34.52 30.5,34.52 arc-45 29.44,34.96 27.69,36.71 arc45 26.99,37 24.72,37 arc-45 23.83,37.37 22.89,38.31 arc45 22.19,38.6 21.65,38.6 arc-90 20.4,39.85 v20.4,40.5
BTN_END  (via drill 0.3)
  Top 0.2: S17.2 93.57,62.9 arc45 93.86,62.19 94.01,62.04 arc-45 94.3,61.34 94.3,60.46 arc-45 94.15,60.1 arc45 94.05,59.85 94.05,46.9 arc-90 93.05,45.9 83.25,45.9 83.18,45.83 81.7,45.83 arc90 79.7,43.83 79.7,37.05 arc-45 79.33,36.16 77.79,34.62 arc45 77.5,33.92 77.5,31.19 arc-45 77.21,30.48 77.1,30.37 arc45 76.95,30.02 76.95,29.77 77,29.72 v77,29.4
  Bottom 0.15: IC4.2 77.3,28.69 arc45 v77.01,29.39 v77,29.4
BTN_MENU  (via drill 0.3)
  Top 0.15: S14.B1 v26.55,52.15 | v43.8,64.5 52.03,64.5 arc-45 52.74,64.21 52.88,64.07 arc45 53.58,63.77 54.82,63.77 arc45 55.52,64.07 55.66,64.21 arc-45 56.37,64.5 59.03,64.5 arc-45 59.73,64.21 60.17,63.77 arc45 60.88,63.48 arc-45 61.13,63.37 64.82,59.68 arc-45 64.88,59.54 64.88,59.48 arc90 65.38,58.98 65.44,58.98 arc-45 65.58,58.92 v66.25,58.25
  Top 0.3: S14.2 17.6,52.3 S14.B2 18.89,50.75 arc45 19.59,51.04 20.01,51.46 arc-45 20.71,51.75 20.89,51.75 arc-45 21.59,51.46 22.01,51.04 arc45 22.71,50.75 S14.B1
  Bottom 0.15: v43.8,64.5 28.55,64.5 arc90 26.55,62.5 v26.55,52.15 | IC1.102 66.75,57.2 arc-90 66.25,57.7 v66.25,58.25
BTST
  Bottom 0.15: IC8.21 38.34,23.75 37.84,23.25 C37.1
CC_!HIB  (via drill 0.3)